# EasyEDA Pro project ProPrj_Avaota A1 八核 AIoT 开发板_2024-05-03.epro, board PCB1 (continued)
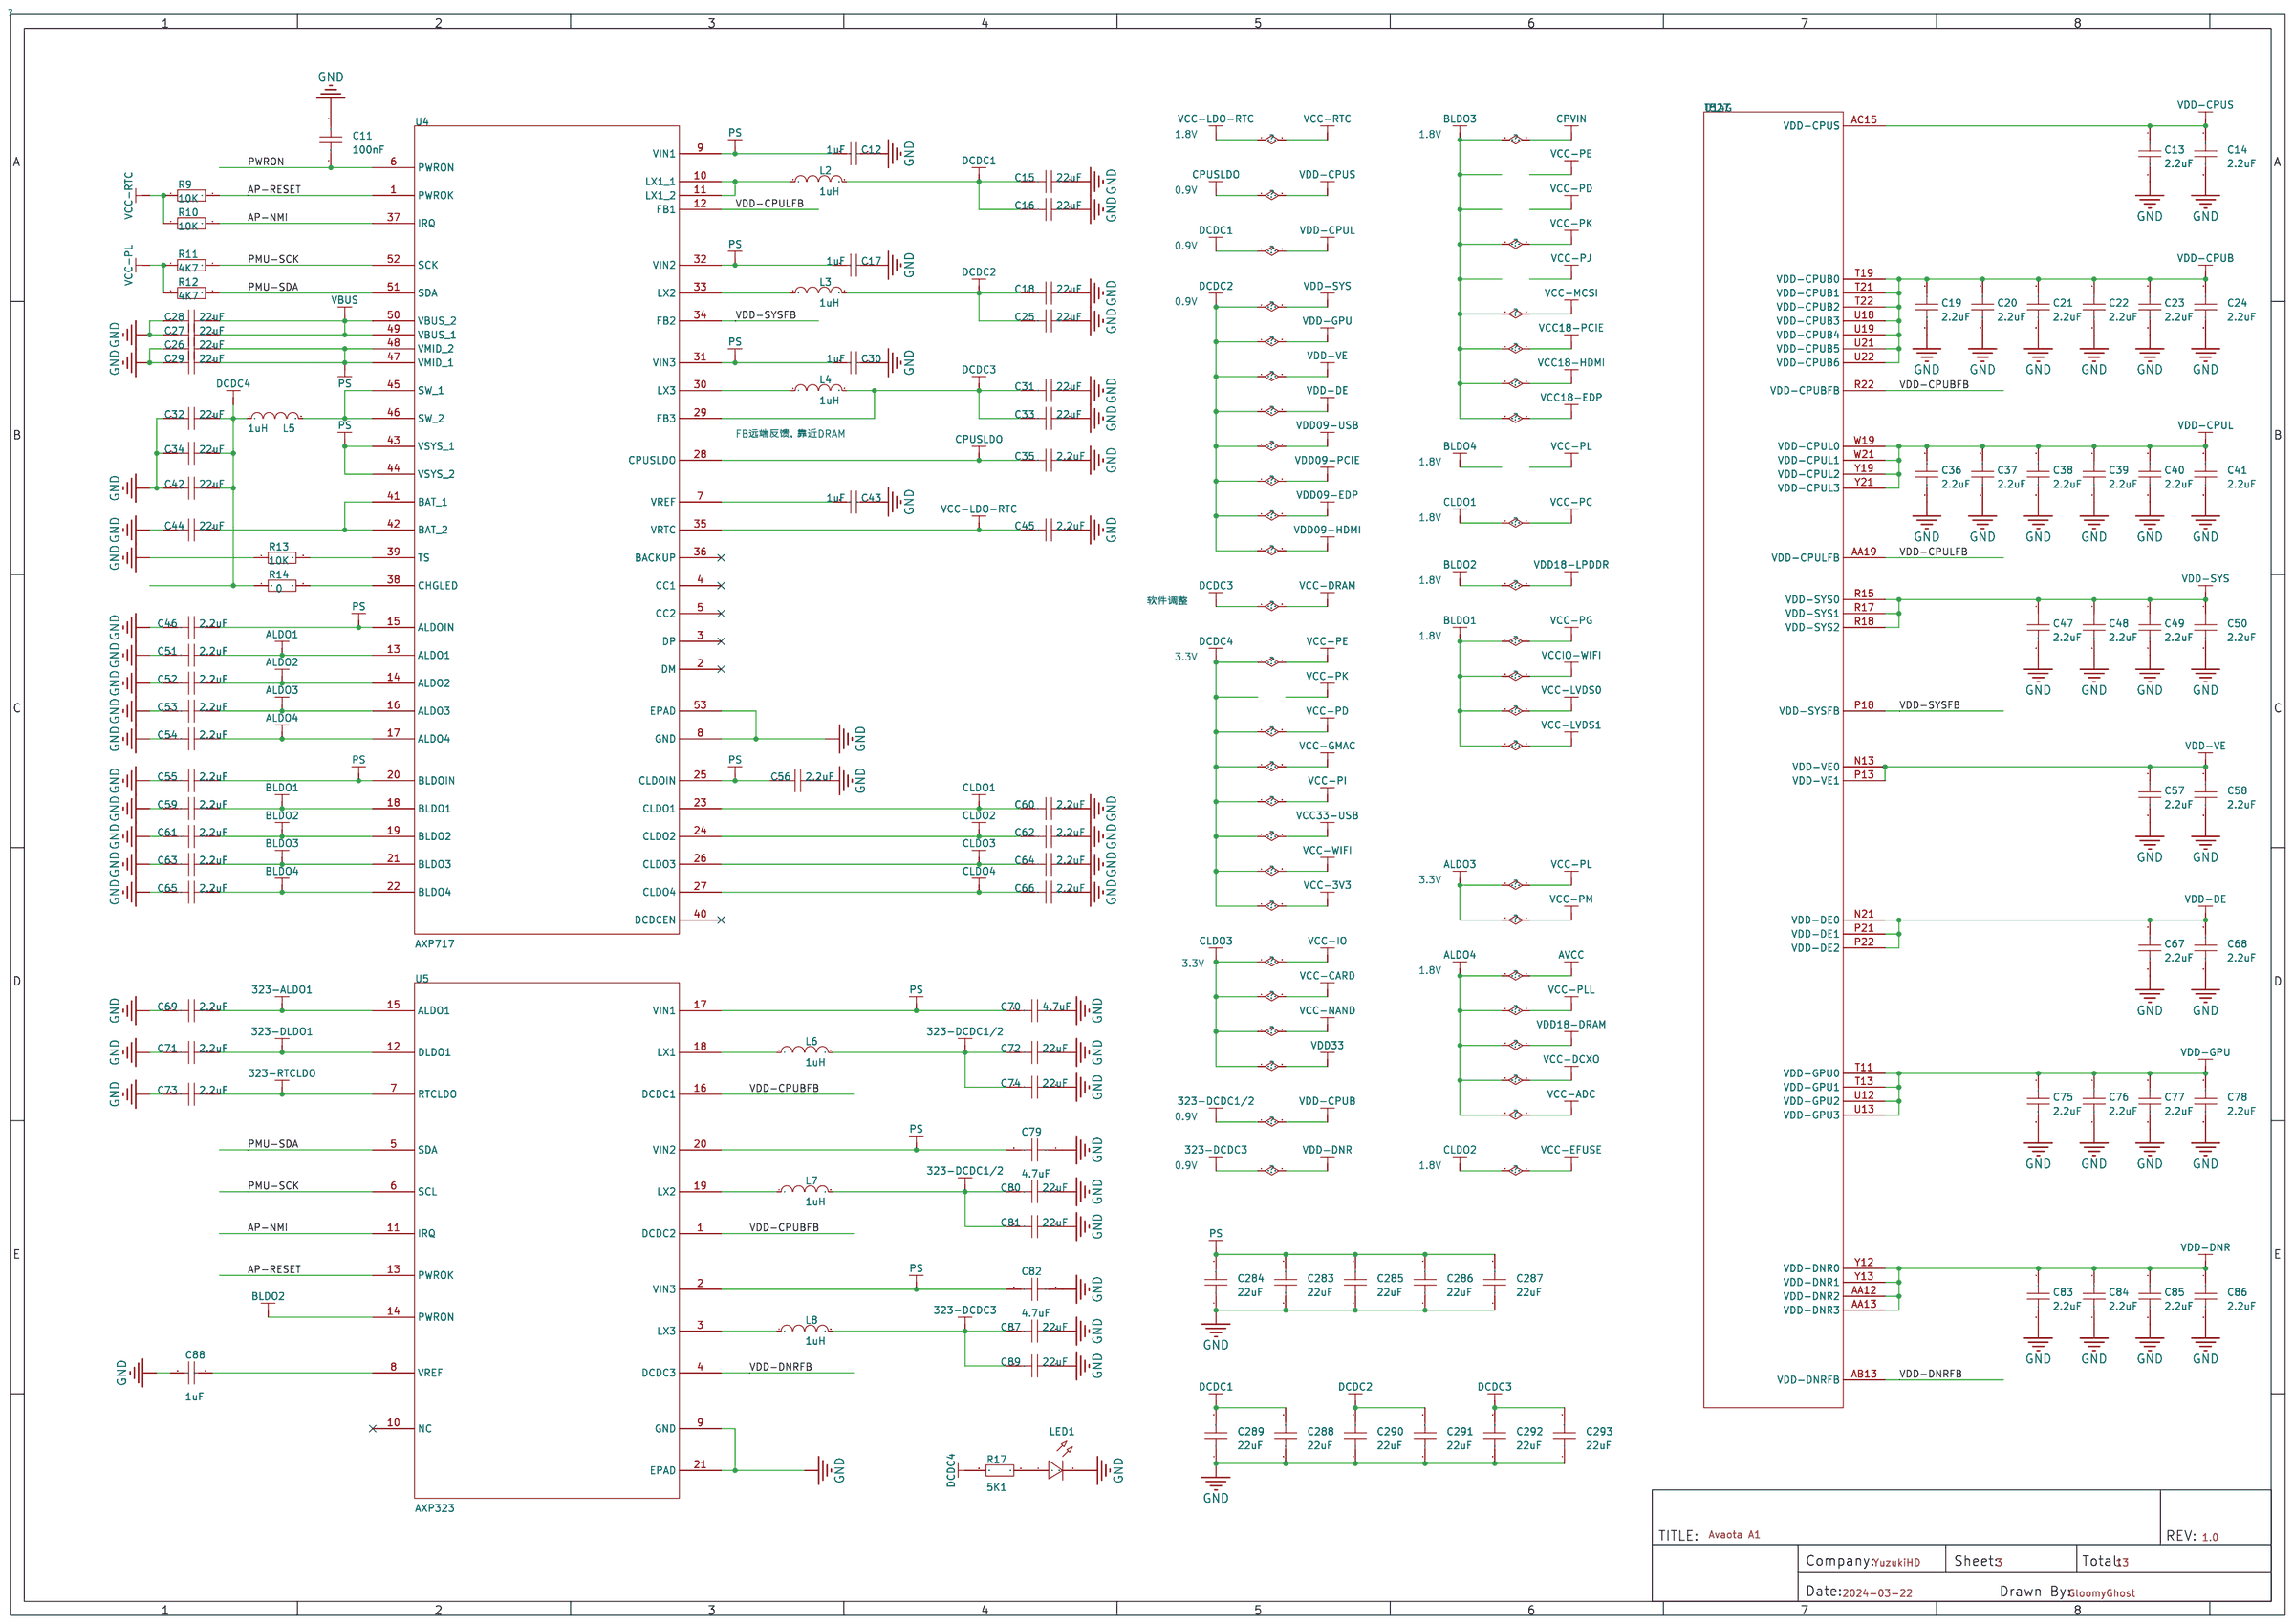
[diagram p0: POWER]
## Routing (per net, layer and track width the routed paths; a pad name or vN(x,y) marks a point on that pad's centre or on a via; arc(x,y) is an arc through that point) (continued)
CLDO4: length 2.2
  Top Layer w0.203: C66.2 12.79,55.45 12.6,55.45 12.34,55.19 11.51,55.19 U4.27
CPUSLDO: length 54.6
  Top Layer w0.203: U14.AC15 v2(58.44,50.37) ; U4.28 10.67,54.75 10.67,55.12 10.85,55.3 11.1,55.3 11.3,55.5 12.17,55.5 12.67,56.01 13.76,56.01 14.05,55.72 14.05,55.6 C35.2 14.22,55.58 15.14,54.66 v2(15.14,53.92)
  Bottom Layer w0.203: v2(58.44,50.37) 58.26,50.19 57.81,50.19 57.18,50.83 52.32,50.83 51.79,50.29 51.44,50.29 51.1,50.62 51.1,51.21 47.17,55.14 16.28,55.14 15.14,54 v2(15.14,53.92)
CPUX-RX: length 120.9
  Top Layer w0.127: D30.2 87.99,67.11 v2(87.66,67.43) 87.4,67.69 USB3.B8 ; v1(62.95,42.15) U14.R29
  内层2 w0.102: H1.10 19.33,71.96 19.33,69.29 20.22,68.4 63.55,68.4 64.21,67.74 82.17,67.74 82.91,68.48 86.61,68.48 87.66,67.44
  VCC w0.102: v2(87.66,67.43) 87.66,67.11 87.25,66.7 84.23,66.7 83.59,67.34 82.45,67.34 80.42,65.3 80.42,53.29 74.93,47.8 v2(74.93,45.52)
  内层4 w0.102: v1(62.95,42.15) 63.81,43 66.09,43 66.6,43.51 69.9,43.51 71.07,44.68 73.89,44.68 74.73,45.52 v2(74.93,45.52)
CPUX-TX: length 115.9
  Top Layer w0.127: USB3.A8 84.4,67.19 D27.2 ; U14.R28 v1(62.95,42.64)
  内层2 w0.102: H1.8 16.87,71.88 16.87,69.85 17.35,69.37 18.82,69.37 20.04,68.15 63.37,68.15 64.06,67.46 82.32,67.46 83.08,68.22 84,68.22 84.4,67.82 v2(84.4,67.34)
  VCC w0.102: v2(74.42,45.8) 74.63,46 74.63,48.03 80.09,53.49 80.09,65.46 82.25,67.62 83.74,67.62 84.01,67.34 v2(84.4,67.34)
  内层4 w0.102: v1(62.95,42.64) 63.56,43.26 65.94,43.26 66.47,43.79 69.77,43.79 70.92,44.93 73.71,44.93 74.42,45.64 v2(74.42,45.8)
CPVDD: length 1.2
  Top Layer w0.152: U14.AJ3 v1(55.92,55.15)
  Bottom Layer w0.152: v1(55.92,55.15) 55.92,55.85 C105.2
CPVEE: length 3.3
  Top Layer w0.152: U14.AK2 54.94,55.64 v1(54.94,55.19) ; v1(55.92,54.65) U14.AJ4
  Bottom Layer w0.152: v1(54.94,55.19) 55.4,55.65 C115.2 55.45,55.79 55.45,54.99 55.79,54.65 v1(55.92,54.65)
CTP-INT: length 72.6
  Top Layer w0.076: 62.79,40.39 62.78,40.39 ; 62.79,40.39 62.84,40.34 ; 62.79,40.39 62.84,40.35 62.84,40.34 ; 62.79,40.39 62.69,40.48 62.69,40.9 62.44,41.15 ; 62.84,40.34 62.85,40.18 62.85,40.11 62.85,40.09 62.85,39.94 62.75,39.83 62.75,38.31 62.78,38.17 62.92,37.94 63.11,37.67
  Top Layer w0.102: v1(63.35,36.42) 63.22,36.55 63.22,37.57 63.12,37.67
  Inner5 w0.127: v1(25.1,23.72) 25.43,24.05 25.43,29.29 28.6,32.46 42.57,32.46 45.21,35.1 60.93,35.1 62.26,36.42 v1(63.35,36.42)
  Bottom Layer w0.127: FPC1.35 6.45,20.78 7.67,22 18.21,22 19.94,23.72 v1(25.1,23.72)
CTP-RST: length 76
  Top Layer w0.127: v1(62.95,41.65) U14.R30
  内层2 w0.127: v1(24.69,23.27) 25.37,23.27 26.31,24.21 26.31,26.24 26.77,26.7 26.77,32.31 30.61,36.14 36.68,36.14 36.68,36.14 37.62,35.2 38.61,35.2 39.17,34.65 39.17,34.09 39.4,33.86 39.93,33.86 40.59,34.52 41.94,34.52 42.88,33.58 53.06,33.58 55.63,36.14 60.43,36.14 62.51,38.23 62.51,39.17 62.95,39.61 v1(62.95,41.65)
  Bottom Layer w0.127: FPC1.36 6.56,20.28 7.87,21.59 18.49,21.59 20.17,23.27 v1(24.69,23.27)
CTP-SCK: length 72.5
  Top Layer w0.076: 62.44,40.5 62.54,40.38 62.68,40.26 62.69,40.17 62.69,40 62.57,39.89 62.57,38.33 62.63,38.04 62.82,37.77 62.91,37.53 ; 62.44,40.5 62.44,40.65
  Top Layer w0.102: 62.92,37.53 62.97,37.48 62.97,36.09 v1(63.09,35.97)
  Inner5 w0.127: v1(24.26,22.83) 24.36,22.73 24.84,22.73 25.78,23.67 25.78,29.08 28.73,32.03 42.8,32.03 45.44,34.67 61.06,34.67 62.36,35.97 v1(63.09,35.97)
  Bottom Layer w0.127: v1(24.26,22.83) 20.42,22.83 18.8,21.21 8.08,21.21 6.65,19.78 FPC1.37
CTP-SDA: length 71.9
  Top Layer w0.076: 62.42,40.12 62.37,39.87 62.38,39.71 62.31,39.51 62.32,39.2 62.31,38.78 62.33,38.32 62.49,37.77
  Top Layer w0.102: 62.48,37.77 62.6,37.63 62.67,37.56 62.67,35.63 v1(62.74,35.56)
  Inner5 w0.127: v1(62.74,35.56) 61.42,34.24 45.59,34.24 42.98,31.62 28.88,31.62 26.14,28.88 26.14,23.44 24.97,22.28 23.93,22.28 v1(23.83,22.38)
  Bottom Layer w0.127: v1(23.83,22.38) 20.65,22.38 19.08,20.8 8.2,20.8 6.68,19.28 FPC1.38
DCDC1: length 4.6
  Bottom Layer w0.254: 60.44,47.65 v2(60.44,47.15) 60.16,46.86 ; 60.44,47.65 60.82,47.65 C39.1 ; 60.44,47.65 60.44,47.66 C38.1 ; 60.16,46.86 60.16,46.93 v2(59.94,47.15) 59.94,47.68 C36.1 C37.1 59.4,47.74 C40.1 ; 60.16,46.86 C41.1 60.16,46.43 ; 60.16,46.43 v2(60.44,46.15) ; 60.16,46.43 60.16,46.36 v2(59.94,46.15)
  vias: v1(11.89,47.68) v1(11.89,46.96) v1(11.89,46.34) v1(12.4,47.26) v1(12.4,46.66) v1(12.4,46.13)
DCDC2: length 24.5
  Top Layer w0.254: C218.2 8.41,59.08 v1(8.31,58.98) ; v1(7.77,58.98) 7.87,59.08 C210.2 ; v1(61.95,50.67) 61.94,50.68 U14.T11 ; v1(61.95,50.67) 61.47,50.67 U14.U12 U14.U13 U14.T13 61.95,50.14 v1(61.95,49.61) 62.15,49.61 62.44,49.32 U14.R15 62.43,49.14 v2(62.43,48.62) 62.43,48.15 ; v1(61.95,50.67) 62.43,50.67 v1(62.46,50.65) v1(62.94,50.65) ; U14.P21 U14.P22 ; U14.P21 62.97,46.17 v2(62.97,46.63) ; U14.P21 U14.N21 U14.M22 U14.L21 ; U14.P21 62.49,46.15 v2(62.46,46.18) v2(62.46,46.63) ; v2(61.95,48.16) 62.43,48.16 62.43,48.15 ; U14.J16 v2(65.86,48.65) ; v2(63.96,48.13) 63.96,48.13 U14.L18 ; v1(62.94,50.65) U14.N13 ; v1(62.94,50.65) 62.94,50.15 ; 62.43,48.15 U14.R17 U14.R18
  Bottom Layer w0.152: C213.2 66.32,52.15 ; 66.32,52.15 C214.2 ; 66.32,52.15 66.43,52.03 66.43,51.61
  Bottom Layer w0.254: C75.1 63.41,51.13 62.94,51.13 ; C58.1 65.86,48.58 v2(65.86,48.65) 65.86,48.96 C57.1 C67.1 C68.1 C215.2 C216.2 65.77,51.6 ; v1(62.46,50.65) 62.46,51.13 C78.1 ; v1(62.94,50.65) 62.94,51.13 ; 62.94,51.13 C76.1 ; 65.77,51.6 C211.2 C213.2 ; 65.77,51.6 66.42,51.6 66.43,51.61 ; 62.43,46.98 62.46,46.95 v2(62.46,46.63) v2(62.46,46.18) 62.95,46.18 C48.1 v2(62.97,46.63) C49.1 ; v1(61.95,49.61) 62.1,49.61 62.42,49.29 C47.1 62.43,49.06 v2(62.43,48.62) ; v1(61.95,50.67) 61.95,51.12 C77.1
  vias: v1(6.22,58.29) v1(6.76,58.29) v1(7.77,58.5) v1(8.33,58.5)
DCDC3: length 138.9
  Top Layer w0.115: 44.61,50.01 44.61,49.9 44.62,49.88
  Top Layer w0.203: 42.21,44.85 42.27,44.78 42.98,44.78 43.61,44.15 43.61,43.51
  Top Layer w0.254: 40.18,43.31 40.18,43.26 40.31,43.26 40.61,43.55 ; 42.21,52 42.9,52 43.2,52.31 v3(43.2,52.4) ; v3(38.43,54.58) 38.5,54.51 39.25,54.51 39.81,53.95 ; v1(10.06,54.1) 10.26,54.31 U4.29 ; 39.01,43.55 38.82,43.74 v3(38.5,43.74) ; v3(34.57,50.94) 34.81,50.7 35.01,50.7 ; v3(37.11,52.37) 36.98,52.37 36.61,52 ; 33.41,48.1 33.41,47.99 v3(33.14,47.73) 33.02,47.85 32.23,47.85 32.23,47.27 ; 36.61,40.95 37.08,40.95 v3(37.16,40.87) ; 39.01,44.85 39.33,44.53 39.37,44.53 39.37,44.52 v3(39.37,44.52) ; 35.01,48.1 34.86,47.95 v3(34.86,47.56) ; 33.41,52 33.27,52 v3(32.97,52.3) 32.87,52.4 32.87,53.12 32.52,53.47 32.23,53.47 32.23,54.1 ; 42.64,46.08 42.57,46.15 42.21,46.15 ; 39.81,40.3 39.83,40.27 39.83,39.97 39.85,39.95 39.85,39.86 v3(39.87,39.85) ; v3(42.57,48.18) 42.48,48.1 42.21,48.1 ; 42.21,42.25 42.53,42.25 v3(42.59,42.19) ; 36.61,53.3 37.02,53.3 v3(37.06,53.26) 37.56,53.26 v3(37.84,52.98) 37.84,53.42 38.12,53.7 38.67,53.7 39.01,53.36 39.01,53.3 ; 39.01,52 39.01,51.94 v3(38.53,51.46) ; v3(41.48,54.53) 41.02,54.08 41.02,53.85 40.61,53.43 40.61,53.3 ; v3(40.99,50.39) 40.91,50.39 40.61,50.7 ; 35.81,40.3 35.81,39.9 v3(35.68,39.78) 35.12,39.22 32.54,39.22 32.23,39.52 ; 33.41,44.85 33.11,45.14 v3(33.01,45.14) ; v3(33.73,49.07) 33.41,49.4 ; 40.61,48.1 40.71,48.1 v3(41,48.39) ; 33.01,45.86 32.66,45.52 32.23,45.52 32.23,44.91 ; 33.01,45.86 v3(33.07,45.92) 33.18,45.92 33.41,46.15 ; 33.01,45.86 v3(33.01,45.14) ; v3(35.85,54.44) 35.81,54.4 35.81,53.95 ; v3(35.41,53.7) 35.4,53.7 35.01,53.3 ; v3(37.07,44.7) 36.92,44.85 36.61,44.85 ; v3(37.59,49.91) 37.59,49.65 37.84,49.4 39.01,49.4 ; v3(33.01,45.14) 33,45.12 ; 36.61,49.4 36.61,49.41 37.05,49.86 v3(37.05,49.87) 37.05,50.25 36.61,50.7 ; v3(32.26,48.92) 32.23,48.95 32.23,49.36 ; 35.01,43.55 34.99,43.55 v3(34.67,43.87) ; v3(37.16,43.74) 36.97,43.55 36.61,43.55 ; v3(34.63,41.26) 34.63,41.26 34.94,40.95 35.01,40.95 ; v3(44.19,43.74) 43.96,43.51 43.61,43.51 ; 42.21,49.4 43.61,49.4 v3(43.66,49.45) 43.74,49.53 44.4,49.53 44.68,49.81 44.68,50 44.66,50.01 ; 39.01,42.25 39.34,41.91 v3(39.39,41.91) ; 32.23,41.22 32.23,41.88 32.33,41.99 v3(32.97,41.99) 33.23,42.25 33.41,42.25 ; v3(40.99,46) 40.84,46.15 40.61,46.15 ; v3(40.99,40.56) 40.99,40.56 40.61,40.95 ; v3(38.12,49.91) 38.12,49.94 38.5,50.32 38.62,50.32 39.01,50.7 ; 35.01,46.15 35.01,46.16 v3(35.48,46.63) ; 36.61,42.25 37.1,42.25 v3(37.18,42.16) ; 39.01,40.95 39.01,40.9 v3(39.37,40.54)
  内层4 w0.076: v3(37.18,42.16) 37.97,42.29 38.23,42.16 38.23,41.88 38.14,40.95
  内层4 w0.102: v3(39.37,40.54) 38.96,40.95 37.23,40.95 v3(37.16,40.87)
  内层4 w0.254: v3(58.43,48.14) 54.85,48.14 54.46,48.54 52.58,48.54 45.39,55.73 19.68,55.73 16.61,58.8 14.45,58.8 13.74,59.51 11.15,59.51 9.88,58.24 9.88,54.28 v1(10.06,54.1)
  Bottom Layer w0.203: v3(41,48.39) 40.89,48.28 40.89,47.9 ; 34.67,47.98 34.67,47.75 v3(34.86,47.56) ; v3(38.12,49.91) v3(37.59,49.91) ; v3(41.48,54.53) 41.42,54.48 41.42,54.31
  Bottom Layer w0.254: 34.75,53.7 v3(35.41,53.7) ; 36.43,40.95 37.08,40.95 v3(37.16,40.87) ; v3(35.48,46.63) 35.94,46.63 36.07,46.76 ; 39.27,39.95 39.27,40.44 v3(39.37,40.54) ; 43.17,51.87 43.17,52.36 v3(43.2,52.4) ; 40.01,39.27 40.01,39.7 v3(39.87,39.85) ; 33.79,40.66 34.39,41.25 34.61,41.25 v3(34.63,41.26) ; v3(37.18,42.16) 37.08,42.06 36.6,42.06 ; 39.02,54.28 38.73,54.28 v3(38.43,54.58) ; v3(34.57,50.94) 34.62,50.99 35.59,50.99 ; 39.8,41.91 v3(39.39,41.91) ; v3(34.67,43.87) C117.1 ; v3(32.26,48.92) 32.54,49.2 33.6,49.2 v3(33.73,49.07) ; v3(37.07,44.7) 37.49,44.28 37.49,44.07 v3(37.16,43.74) ; 43.83,44.22 43.83,44.1 v3(44.19,43.74) ; v3(37.59,49.91) 37.72,49.78 37.72,49.34 37.58,49.34 v3(37.05,49.87) ; v3(37.11,52.37) 37.06,52.43 v3(37.06,53.26) ; v3(42.59,42.19) 42.59,42.34 42.95,42.7 43.2,42.7 ; R38.2 59.41,44.62 v3(59.43,44.64)
  Bottom Layer w0.305: v3(58.43,44.64) 58.43,44.26 C155.2 ; v3(58.43,44.64) v3(58.93,44.64) ; v3(58.43,44.64) 57.98,45.1 57.98,45.52 ; 59.94,44.22 59.94,44.63 v3(59.93,44.64) ; v3(58.93,44.64) v3(59.43,44.64) v3(59.93,44.64) ; v3(58.93,44.64) 58.93,44.25 C119.2 ; 57.98,45.52 58.31,45.52 v3(58.43,45.64) ; 57.98,45.52 57.96,45.53 57.96,46.63 58.42,46.63 v3(58.43,46.64) ; v3(59.93,44.64) v3(60.43,44.64) ; v3(60.43,44.64) v3(60.43,44.14) ; v3(60.43,44.64) 60.43,45.13 v3(60.43,45.14) ; 57.96,47.65 58.43,47.65 v3(58.43,47.64) v3(58.43,48.14) ; 58.43,47.14 57.96,47.14
  vias: v1(11.4,57.96) v1(11.38,57.28) v1(11.86,57.28) v1(11.86,56.72) v1(11.89,57.96) v1(12.37,57.25) v3(40.18,43.31) v3(42.64,46.08) v3(58.43,47.14)
DCDC4: length 460.7
  Top Layer w0.102: v1(78.59,23.98) 79.13,23.98 C271.1 79.65,23.99 R110.2 R106.1 ; C269.1 80.39,18.75 v1(80.82,19.18) 81.08,19.18 81.79,19.89 81.79,20.4 81.88,20.49 U13.40 ; v1(89.74,21.97) 89.74,21.91 R101.1
  Top Layer w0.127: 61.07,24.66 R92.2 61.06,24.57 60.98,24.57 ; 61.07,24.66 60.98,24.57 ; 61.07,24.66 R88.1 ; 60.98,24.57 C263.1 ; U12.11 69.8,20.63 69.98,20.45 C264.1 71.41,20.98 R90.1 ; R83.1 71.91,21.84 v1(71.96,21.9) ; U12.40 63.55,20.63 63.37,20.45 v2(63.37,20.09) 62.05,18.77 C262.1
  Top Layer w0.152: v2(16.84,57.83) 16.84,55.8 16.1,55.07 16.1,52.11 16.07,52.07 ; 67.31,27.27 67.34,27.24 ; U13.11 88.28,20.49 v1(88.49,20.27) 88.99,20.27 arc(89.14,20.41) 89.31,20.55 arc(89.44,20.68) R108.1 ; v1(62.94,52.58) U14.P9
  Top Layer w0.178: R107.2 85.37,27.33 85.22,27.48 84.51,27.48 84.12,27.86 v2(83.87,27.86) ; R109.2 87.07,27.33 87.38,27.64 88.01,27.64 88.34,27.31 88.34,25.88 88.67,25.55 90.09,25.55 90.53,25.12 90.53,24.28 89.74,23.5 v1(89.74,21.97)
  Top Layer w0.203: C258.1 83.19,26.51 83.19,25.78 83.36,25.61 83.36,24.79 ; 83.76,24.79 v1(83.76,25.84) 83.67,25.93 83.67,26.37 83.77,26.47 ; U12.29 65.2,25.91 v1(65.13,25.98) C250.1 ; U12.28 65.6,25.92 65.63,25.96 v2(65.63,26.71)
  Top Layer w0.254: v1(4.78,56.72) R14.1 ; v2(64.95,46.66) 64.94,46.67 U14.K19 ; v1(60.02,24.56) 60.47,24.56 C263.1 ; v2(91.41,38.36) v2(91.08,38.68) 91.08,39.19 90.55,39.73 89.48,39.73 88.68,40.53 88.68,44.36 89.26,44.93 v2(89.99,44.93) ; v2(67.34,27.69) 67.31,27.66 67.31,27.27 ; v1(94.06,17.63) 94.1,17.59 R124.2 R125.2 ; v2(50.19,26.19) 50.19,25.31 R61.1 ; 69.19,27.24 69.19,27.46 69.01,27.64 ; v2(65.46,46.66) 65.44,46.67 U14.J19 U14.J18 64.94,48.15 U14.L17
  Top Layer w0.508: U9.9 v2(16.84,57.83)
  内层2 w0.33: v2(64.44,49.1) 64.95,48.59 v2(64.95,46.66) 64.8,46.66 63.32,45.19 61.14,45.19 60.71,45.62 59.46,45.62 58.93,46.15 58.93,48.36 58.64,48.65 v2(57.44,48.65)
  VCC w0.152: v1(4.78,56.72) 4.7,56.79 3.25,56.79
  VCC w0.254: v1(88.49,20.27) 90.02,20.27 90.27,20.02 92.66,17.63 v1(94.06,17.63) ; 64.03,20.75 64.47,20.32 70.1,20.32 v2(70.21,20.42) ; v2(50.19,26.19) 50.19,23.45 50.18,23.44 ; 65.63,25.98 65.63,25.99 v2(65.63,26.71)
  VCC w0.381: 65.02,41.12 65.43,41.53 65.43,46.63 v2(65.46,46.66) ; v1(62.94,52.58) 62.94,52.2 63.09,52.04 64.24,52.04 v2(64.39,52.2) 64.95,51.64 v2(64.95,46.66) 64.95,44.15 v1(64.44,43.65) 64.44,43.64 64.44,41.45 64.67,41.22
  VCC w0.508: 81.52,23.98 81.52,23.99 v1(83.25,25.72) 83.63,25.72 v1(83.76,25.84) 83.69,25.91 83.69,26.97 83.87,27.15 v2(83.87,27.86) ; 52.39,18.73 52.83,19.17 52.83,23.34 52.73,23.44 ; 15.01,68.71 15.88,67.84 15.88,58.79 v2(16.84,57.83)
  VCC w0.762: 82.32,20.68 82.91,20.09 87.71,20.09 ; 82.32,20.68 82.32,23.32 81.67,23.98 v1(78.59,23.98) 78.59,24.05 76.66,25.98 v1(65.13,25.98) 64.05,25.98 62.69,24.62 ; 82.32,20.68 v1(80.82,19.18) ; 70.76,27.39 70.76,26.59 70.38,26.21 ; 70.76,27.39 70.76,28.55 65.73,33.59 65.73,40.12 64.74,41.1 ; 70.76,27.39 70.47,27.69 v2(69,27.69) v2(67.34,27.69) ; 87.71,20.09 88.5,20.09 ; 87.71,20.09 90.27,20.02 90.75,20.02 92.53,21.79 92.53,37.24 v2(91.41,38.36) v2(91.08,38.68) ; 62.69,24.62 62.63,24.56 v1(60.02,24.56) ; 62.69,24.62 63.03,24.62 64.03,23.62 64.03,20.75 v2(63.37,20.09)
  VCC w1.27: 28.22,70.69 26.14,68.61 5.82,68.61 ; 3.25,53.14 3.25,66.04 5.82,68.61 ; 5.82,68.61 7.9,70.69 ; v1(60.02,24.56) 58.9,23.44 48.74,23.44 46.38,25.81 40.11,25.81 38.53,24.23 32.58,24.23 26.43,18.09 6.07,18.09 1.57,22.58 1.57,51.13 3.46,53.01 v1(3.56,53.01)
  Bottom Layer w0.254: 95.02,16.66 95.35,16.33 95.35,6.5 91.54,2.69 90.84,2.69 ; 95.02,16.66 v1(94.06,17.63) ; 95.02,16.66 98.32,16.66 98.59,16.93 C204.2 U11.5 ; 52.73,20.73 52.4,21.05 C224.2 ; 52.73,20.73 53.19,21.19 C223.2 ; 52.73,20.73 52.73,19.07 52.39,18.73 ; 65.31,46.89 65.46,46.75 v2(65.46,46.66) C176.2 ; 93.34,29.85 93.46,29.96 FPC2.4 ; 93.34,29.85 v2(92.74,29.85) ; 93.34,29.85 92.96,29.46 ; C167.2 64.93,46.68 v2(64.95,46.66) 64.92,46.63 C175.2 ; C174.2 C173.2 64.39,49.15 v2(64.44,49.1) ; v1(64.44,43.65) 64.44,43.21 C169.2 ; v2(1.93,36.32) 1.98,36.28 FPC1.4 ; RJ2.14 90.84,2.69 ; 90.84,2.69 80.05,2.69 78.84,1.48 78.55,1.78 74.06,1.78 RJ1.14 72.29,3 62.07,3 RJ1.11 ; v2(1.96,36.88) 2.05,36.78 5.51,36.78 FPC1.3 ; FPC2.3 92.96,29.46 ; 92.96,29.46 92.68,29.18 92.91,28.96 FPC2.2 ; C170.2 64.44,52.25 v2(64.39,52.2) ; v2(89.99,44.93) 90.07,44.93 90.45,45.31 90.45,48.11 88.72,49.84 U16.5 89.19,50.53 C276.1
  Bottom Layer w0.33: C177.2 57.39,48.64 C178.2
  Bottom Layer w0.381: v1(83.76,25.84) 83.77,25.83 86,25.83 86.28,26.11 86.94,26.11 87.27,25.78 87.27,24.56 88.01,23.83 89.41,23.83 89.89,23.34 89.89,22.12 v1(89.74,21.97)
  Bottom Layer w0.635: 69.93,27.69 70.56,27.05 70.56,26.14 69.16,24.74 69.16,22.5 69.77,21.9 71.91,21.9 ; v2(69,27.69) 69.02,27.71 69.82,27.71
  vias: v1(3.56,53.54) v1(4.09,53.54) v1(4.11,53.04) v1(4.6,53.52) v2(92.74,29.24)
DCIN-5V: length 9.1
  Top Layer w0.254: D3.1 7.74,43.18 9.77,41.15 13.08,41.15 14.22,40.01 R3.2
DCIN-12V: length 7.5
  Top Layer w0.254: 11.99,30.28 U3.2 12.12,30.63 12.52,30.63 12.65,30.51 12.65,29.79 12.9,29.54 12.9,29.36 13.33,28.93 14.33,28.93 14.58,28.68 14.58,27.91 14.81,27.69 16.03,27.69 16.19,27.85 R4.2
DCXO-XIN: length 5.7
  Top Layer w0.102: U14.AM13 53.64,50.44 53.21,50.44 53.11,50.34 51.09,50.34 C99.2 50.44,50.36 49.56,50.36 49.02,50.9 X1.1
DCXO-XOUT: length 3.7
  Top Layer w0.102: U14.AN13 51.12,50.15 C98.2 50.35,49.8 X1.3
DDR-PARA-SEL-ADC1: length 4.3
  Top Layer w0.076: 60.44,55.64 60.44,55.79 60.69,56.04 60.69,56.23 60.55,56.42 60.36,56.46 60.18,56.9 60.09,57.34
  Top Layer w0.102: 60.1,57.35 60.1,58.5 59.79,58.8 R31.1 R34.2
DDR-PARA-SEL-ADC2: length 6.2
  Top Layer w0.076: 59.64,57.21 59.64,57.21 59.82,56.37 60.18,55.85 60.19,55.39 60.44,55.14
  Top Layer w0.102: 59.64,57.2 59.64,57.21 59.59,57.26 59.59,58.12 59.41,58.29 58.8,58.29 58.55,58.55 57.9,58.55 R35.2 R32.1
DSP-UART-RX: length 19.9
  Bottom Layer w0.102: H1.40 56.16,73.1 54.91,71.86 54.91,69.95 54.15,69.19 54.15,61.6 52.27,59.72 52.27,58.22 52.4,58.09 52.4,57.34 52.92,56.82 53.26,56.82 53.49,56.59 53.49,55.73 v2(53.44,55.68)
DSP-UART-TX: length 17.5
  Top Layer w0.102: v2(51.94,57.76) 51.94,57.07 52.65,56.36 52.65,55.42 52.93,55.15 U14.AN3
  Bottom Layer w0.102: 53.87,64.66 53.87,61.77 51.94,59.84 v2(51.94,57.76) ; 53.87,64.66 53.87,64.74 ; 53.87,64.66 53.87,70.43 53.62,70.69
EDP-AUXN: length 41.7
  Top Layer w0.076: 70.05,38.1 70.05,38.13 69.6,38.58 69.6,38.83 68.49,39.94 68.49,40.1 68.44,40.14
  Top Layer w0.127: C199.1 49.56,25.44 49.56,25.72 v1(49.66,25.82) ; 70.05,38.1 73.25,34.9 73.25,34.4 74.24,33.41 74.24,30.96 72.87,29.59 62.64,29.59 59.14,26.09 v1(58.93,26.09)
  内层2 w0.127: v1(49.66,25.82) 49.45,25.62 49.45,25.4 49.58,25.27 49.89,25.27 50.02,25.4 50.02,25.68 50.15,25.81 50.27,25.81 50.4,25.68 50.4,25.4 50.53,25.27 50.66,25.27 50.78,25.4 50.78,25.68 50.91,25.81 51.04,25.81 51.16,25.68 51.16,25.4 51.29,25.27 52.04,25.27 52.29,25.03 58.08,25.03 58.93,25.88 v1(58.93,26.09)
EDP-AUXP: length 41.5
  Top Layer w0.076: 68.44,40.64 68.69,40.39 68.69,40.04 68.68,40.03 68.68,40 69.82,38.85 69.82,38.65 70.22,38.26
  Top Layer w0.127: 70.22,38.26 73.48,34.99 73.48,34.49 74.47,33.5 74.47,30.87 72.99,29.39 62.76,29.39 59.26,25.88 v1(59.26,25.68) ; C198.1 49.23,25.44 49.23,25.72 v1(49.12,25.82)
  内层2 w0.127: v1(59.26,25.68) 59.23,25.71 59.08,25.71 58.17,24.8 52.19,24.8 52,24.99 49.51,24.99 49.22,25.28 49.22,25.72 v1(49.12,25.82)
EDP-HPD: length 41.8
  Top Layer w0.127: 51.09,25.32 50.95,25.32 50.64,25.01 D12.4 v1(50.64,22.2) ; 51.09,25.32 R60.2 ; 51.09,25.32 51.09,26.23 v1(51.1,26.24) ; v1(67.93,42.15) U14.C29
  内层2 w0.127: v1(51.1,26.24) 57.73,32.87 66.32,32.87 66.85,33.4 66.85,34.7 70.51,38.35 70.51,41.25 69.61,42.15 v1(67.93,42.15)
  Bottom Layer w0.127: 52.39,17.43 52.06,17.43 51.56,17.93 51.56,18.59 51.1,19.05 50.9,19.05 50.5,19.46 50.5,22.06 v1(50.64,22.2)
EDP-TX0N: length 40.5
  Top Layer w0.076: 72.8,40.64 72.77,40.67 71.83,40.67 70.6,41.89 69.19,41.89 68.94,42.14
  Top Layer w0.127: v1(56.34,25.83) 56.44,25.73 56.44,25.43 C191.1 ; v1(75.52,32.71) 75.7,32.53 75.7,32.29 75.75,32.25 76.42,32.25 77.44,33.27 77.44,36.14 72.95,40.64 72.8,40.64
  内层2 w0.127: v1(75.52,32.71) 75.39,32.71 75.11,32.99 74.73,32.99 74.29,32.56 74.29,31.31 72.65,29.67 59.47,29.67 56.48,26.68 56.48,26.21 56.34,26.07 v1(56.34,25.83)
EDP-TX0P: length 40.4
  Top Layer w0.076: 72.77,40.84 71.91,40.84 70.68,42.07 69.51,42.07 69.44,42.14
  Top Layer w0.127: v1(56.87,25.83) 56.74,25.71 56.74,25.43 C190.1 ; 72.77,40.84 73.07,40.84 77.67,36.24 77.67,33.15 76.55,32.02 75.65,32.02 75.54,32.13 75.31,32.13 v1(75.1,32.34)
  内层2 w0.127: v1(75.1,32.34) 75.16,32.39 75.16,32.61 75.03,32.74 74.83,32.74 74.55,32.46 74.55,31.24 72.75,29.44 59.56,29.44 56.71,26.58 56.71,26.21 56.87,26.05 v1(56.87,25.83)
EDP-TX1N: length 39.2
  Top Layer w0.076: 68.94,41.64 69.18,41.4 70.23,41.4 70.78,40.86 70.78,40.83
  Top Layer w0.127: v1(54.81,25.86) 54.94,25.73 54.94,25.43 C193.1 ; 70.83,40.76 71.53,40.06 72.38,40.06 76.2,36.24 76.2,35.13 75.84,34.77 75.66,34.77 75.5,34.93 75.5,35.12 v1(75.29,35.33)
  内层2 w0.127: v1(75.29,35.33) 75.05,35.33 74.01,36.37 71.86,36.37 69.14,33.66 69.14,31.83 67.84,30.53 59.01,30.53 54.98,26.5 54.98,26.24 54.81,26.07 v1(54.81,25.86)
EDP-TX1P: length 39
  Top Layer w0.076: U14.A30 69.48,41.61 70.33,41.61 70.94,40.99
  Top Layer w0.127: v1(55.37,25.83) 55.25,25.71 55.25,25.43 C192.1 ; 70.99,40.92 71.63,40.28 72.54,40.28 76.43,36.4 76.43,35.03 75.92,34.52 75.58,34.52 75.34,34.76 75.14,34.76 v1(74.96,34.95)
  内层2 w0.127: v1(55.37,25.83) 55.37,26.08 55.21,26.24 55.21,26.41 59.11,30.3 67.97,30.3 69.37,31.7 69.37,33.56 71.95,36.14 73.91,36.14 74.96,35.1 v1(74.96,34.95)
EDP-TX2N: length 33.1
  Top Layer w0.076: 68.94,41.14 69.07,41.14 69.32,40.89 69.9,40.89 70.76,40.03 70.76,39.99 70.81,39.95
  Top Layer w0.127: 70.81,39.95 71.31,39.45 72.24,39.45 73.48,38.2 73.48,37.64 73.36,37.52 v2(73.13,37.52) ; v1(53.49,25.86) 53.62,25.73 53.62,25.45 C195.1
  内层2 w0.127: v2(73.13,37.52) 73,37.39 72.64,37.39 72.44,37.19 71.61,37.19 68.33,33.9 68.33,32.33 67.41,31.42 58.53,31.42 53.63,26.52 53.63,26.26 53.49,26.12 v1(53.49,25.86)
EDP-TX2P: length 33.1
  Top Layer w0.076: 70.97,40.11 70.97,40.13 70.02,41.07 69.51,41.07 69.44,41.14
  Top Layer w0.127: v2(73.53,37.14) 73.53,37.37 73.74,37.57 73.74,38.3 72.31,39.73 71.35,39.73 70.97,40.11 ; 53.91,25.86 v1(54,25.86) 53.85,25.71 53.85,25.48 C194.1
  内层2 w0.127: v1(54,25.86) 54,26.12 53.86,26.26 53.86,26.43 58.62,31.19 67.51,31.19 68.55,32.23 68.55,33.81 71.7,36.96 72.59,36.96 72.77,37.14 v2(73.53,37.14)
EDP-TX3N: length 32.1
  Top Layer w0.076: 70.6,39.01 70.41,39.2 70.41,39.52 70.31,39.62 69.98,39.62 69.88,39.52 69.7,39.52 69.58,39.65 69.33,39.65 69.01,39.97 69.01,40.07 68.94,40.14
  Top Layer w0.102: v1(51.99,25.81) 52.12,25.68 52.12,25.45 C197.1
  Top Layer w0.127: 70.6,39.01 70.8,38.81 70.92,38.81 71.04,38.68 71.04,38.51 71.17,38.38 71.3,38.38 71.42,38.51 71.42,38.68 71.55,38.81 71.93,38.81 72.03,38.71 v2(72.03,38.46)
  内层2 w0.127: v2(72.03,38.46) 71.83,38.25 71.53,38.25 67.49,34.21 67.49,32.89 66.93,32.33 58.1,32.33 54.26,28.49 54.08,28.49 53.9,28.31 53.9,28.13 53.72,27.95 53.54,27.95 53.36,27.78 53.36,27.6 53.18,27.42 53,27.42 52.82,27.24 52.82,27.06 52.64,26.88 52.46,26.88 52.28,26.7 52.28,26.52 52.15,26.38 52.15,26.22 51.99,26.07 v1(51.99,25.81)
EDP-TX3P: length 32
  Top Layer w0.076: 70.76,39.17 70.64,39.29 70.64,39.55 70.59,39.6 70.59,39.6 70.36,39.83 69.4,39.83 69.19,40.04 69.19,40.25 69.19,40.25 69.19,40.39 68.94,40.64
  Top Layer w0.102: v1(52.53,25.81) 52.4,25.68 52.4,25.46 C196.1
  Top Layer w0.127: v2(72.47,38.2) 72.47,38.61 72.06,39.01 70.92,39.01 70.76,39.17
  内层2 w0.127: v2(72.47,38.2) 72.29,38.02 71.63,38.02 67.72,34.11 67.72,32.79 67.03,32.11 58.19,32.11 52.38,26.29 52.38,26.22 52.53,26.07 v1(52.53,25.81)
EMMC-VDDI: length 3.1
  Top Layer w0.102: v1(42.24,36.5) 41.91,36.17 41.91,35.63 U8.C2
  Bottom Layer w0.254: C233.2 C232.2 ; C232.2 C231.1 ; C232.2 42.47,36.73 v1(42.24,36.5)
FEL: length 92.5
  Top Layer w0.127: U14.F16 v1(66.94,49.15)
  Top Layer w0.152: R22.2 C96.2 24.15,34.44 23.93,34.66 23.93,37.08 26.57,39.73 26.57,46.05 25.68,46.94 23.85,46.94 22.78,48.01 v2(22.78,50.39)
  内层2 w0.152: v2(22.78,50.39) 19.61,53.57 19.61,58.7 v2(19.08,59.23)
  VCC w0.152: v1(66.94,49.15) 66.67,49.15 65.48,50.34 65.48,51.92 64.41,52.98 64.41,55.09 63.6,55.91 61.7,55.91 60.22,57.38 60.22,60.22 59.64,60.81 58.72,60.81 58.42,60.5 49.89,60.5 47.45,62.94 30.63,62.94 24.77,57.07 22.35,57.07 20.19,59.23 v2(19.08,59.23)
GM0_DVDD10: length 28.4
  Top Layer w0.127: v1(69.8,26.73) 69.8,26.72 68.4,25.32 U12.21 ; U12.38 63.08,21.43 v1(62.86,21.21) 62.66,21.01 62.66,20.45 62.08,19.86 61.68,19.86 61.58,19.96 ; C267.1 v1(65.58,19.15) 65.58,19.91 U12.3 ; C266.1 67.6,18.72 v1(67.6,19.18) 67.6,19.93
  Bottom Layer w0.584: 65.58,19.94 66.84,19.94 v1(67.6,19.18) ; 65.58,19.94 64.11,21.41 64.11,21.67 ; 65.58,19.94 v1(65.58,19.15) ; 64.11,21.67 64.11,23.85 61.87,26.09 v1(61.87,26.39) v1(61.87,26.95) ; 64.11,21.67 63.64,21.21 v1(62.86,21.21) ; 64.16,23.95 65.1,24.89 68.22,24.89 69.8,26.47 v1(69.8,26.73)
GM0_INTB: length 2.9
  Top Layer w0.102: U12.31 63.5,24.23 62.99,24.74 62.66,24.74 62.31,25.1 61.58,25.1 61.56,25.12
GM0_LED0: length 2.8
  Top Layer w0.102: 61.56,24.56 62.17,24.56 62.34,24.38 62.81,24.38 63.37,23.83 U12.32
GM0_LED1: length 22.7
  Top Layer w0.102: U12.33 63.13,23.43 v2(62.84,23.72)
  Top Layer w0.152: R80.2 v2(57.99,6.2) R94.2
  内层4 w0.152: v2(57.99,6.2) 57.48,6.7 57.48,19.3 61.14,22.96 62.38,22.96 62.84,23.42 v2(62.84,23.72)
GM0_LED2: length 22.8
  Top Layer w0.127: v2(62.31,23.42) 62.7,23.03 U12.34
  Top Layer w0.152: R96.2 v2(57.4,6.19) R79.1
  内层4 w0.152: v2(62.31,23.42) 62.15,23.27 60.91,23.27 57.12,19.48 57.12,6.47 v2(57.4,6.19)
GM0_MDIN0: length 8.5
  Top Layer w0.127: U12.2 65.2,19.47 65.11,19.38 65.11,18.61 62.81,16.31 62.81,14.68 63.22,14.28 63.81,14.28 64,14.47 RJ1.P3
GM0_MDIN1: length 14.3
  Top Layer w0.127: U12.5 66.4,19.47 66.31,19.38 66.31,17.25 65.41,16.34 65.41,14.63 66.55,13.49 66.55,12.4 67.21,11.74 68.25,11.74 69.08,12.57 RJ1.P7
GM0_MDIN2: length 7.8
  Top Layer w0.127: U12.7 67.2,19.47 67.11,19.38 67.11,17.06 67.86,16.32 67.86,14.58 67.37,14.09 67.37,13.15 RJ1.P6
GM0_MDIN3: length 8.4
  Top Layer w0.127: RJ1.P9 71.62,14.4 71.5,14.28 70.97,14.28 70.38,14.86 70.38,17.25 68.31,19.32 68.31,19.38 68.4,19.47 U12.10
GM0_MDIP0: length 8.5
  Top Layer w0.127: RJ1.P2 63.06,13.23 63.06,14.11 62.59,14.59 62.59,16.41 64.88,18.71 64.88,19.38 64.8,19.47 U12.1